# EAGLE board Backplane (EAGLE 6.6.0), part 2 of 2
## Tracks (layer width: path | path; a pad name or v marks a point on that pad's centre or on a via)
1AVAL
  Top 0.203: R42.1 68,72.38 C22.1 66.01,73.66 65.53,74.14 60.2,74.14 59.03,72.97 51.71,72.97 51.5,73.19 U1.42
2AVAL
  Top 0.203: R28.1 63.37,72.53 C24.1 51.25,72.53 50.7,73.08 U1.41
3AVAL  (via drill 0.6)
  Top 0.203: R7.1 73.15,72.25 C14.1 71.42,73.94 70.56,74.8 58.93,74.8 v58.17,74.04 | v49.89,72.26 49.89,74.12 U1.40
  Bottom 0.203: v58.17,74.04 57.4,73.18 56.49,72.26 v49.89,72.26
+5V  (via drill 0.5, 0.6)
  Top 0.203: v79.76,65.51 80.19,65.08 U13.16 81.61,65.08 81.58,65.05 81.69,65.05 81.79,65.15 81.48,65.15 | 81.79,50.72 81.69,50.82 U14.16 81.69,52.09 v81.58,52.2 | U15.16 81.69,37.76 v81.64,37.82 | U2.8 45.9,95.5 46.08,95.68 v46.08,96.19 | JP1.2 36.27,79.32 36.17,79.22
  Top 0.254: 24.38,154.43 R49.2 24.38,156.83 R11.2 | 99.09,31.7 U11.8 | 99.09,31.7 99.09,32.31 99.11,32.79 99.03,32.87 C5.1 | 99.09,31.7 99.11,31.62 v99.11,31.88 | U1.28 45.25,79.93 C10.1 45.72,82.17 v45.77,82.22 | U1.7 53,80.73 52.83,80.9 52.83,82.37 v52.48,82.73
  Top 0.305: R1.2 96.95,63.04 v97.41,63.5 | 24.38,154.43 23.24,154.43 v22.61,155.07 | 24.38,156.83 24.14,156.83 24,156.97 | R17.2 32.52,156.07 v32.39,156.21 | R4.2 R3.2 66.53,97.43 v66.5,97.46 | U3.8 107.57,71.83 v107.75,72.01
  Bottom 0.203: 79.76,65.41 v79.76,65.51 80.07,65.83 C15.1 | 81.53,52.15 v81.58,52.2 81.99,51.79 C16.1 | 81.53,37.82 v81.64,37.82 81.99,37.47 C21.1 | R2.2 33.51,78.7 34.09,79.27 36.32,79.27 JP1.2 | v45.77,82.22 45.77,80.45 C10.1 | v107.75,72.01 107.59,72.01 107.54,71.96
  Bottom 0.254: v99.11,31.88 99.11,31.93 | v52.48,82.73 52.48,81.06 C11.1
  Bottom 0.305: v97.41,63.5 97.41,63.63 | v22.61,155.07 22.61,155.32 | v32.39,156.21 32.39,156.34 | v66.5,97.46 66.5,97.51 | C20.1 108.2,71.55 v107.75,72.01
  other vias: 88.65,140.34 90.73,140.34 92.76,140.34 94.79,140.34 96.88,140.34 88.65,136.27
  pour Route15 (rank 4): 0.61,0.61 116.38,0.41 116.38,179.93 0.51,179.88
  pour Top: 97.99,140.44 97.99,136.73 97.79,136.53 91.64,136.53 90.98,135.86 90.98,135 90.63,134.65 88.34,134.65 87.78,135.2 87.78,140.59 88.39,141.2 97.18,141.2
+9V  (via drill 0.5)
  Top 0.254: R25.2 97,60.71 v97.38,61.09 | v113.89,100.86 113.59,100.56
  Top 0.305: v112.01,92.94 112.01,93.22 112.52,93.73 | U9.6 113.36,91.11 v113.03,91.19 | v12.83,158.24 12.83,158.75
  Bottom 0.254: v97.38,61.09 98.65,61.09 99.01,61.44 99.01,67.84 97.64,69.22 97.64,70.43 98.5,71.3 100.43,71.3 100.69,71.55 100.69,83.19 99.97,83.9 97.38,83.9 96.93,84.35 96.93,98.43 97.54,99.03 105.46,99.03 107.14,100.71 107.14,100.76 107.75,101.37 113.39,101.37 v113.89,100.86
  Bottom 0.305: R40.1 109.58,90.91 109.86,91.19 111.38,91.19 111.63,91.44 111.63,92.51 v112.01,92.94 | v113.03,91.19 113.03,92.46 114.81,94.23 114.81,163.96 112.78,165.99 106.81,165.99 102.87,169.93 14.99,169.93 13.21,168.15 13.21,158.62 v12.83,158.24
  other vias: 11.13,124.54 12.29,124.54 13.46,124.54 14.68,124.54 11.73,123.42 12.9,123.42 14.07,123.42
  pour Top: 14.99,157.48 14.99,123.7 14.1,122.81 11.05,122.81 10.54,123.32 10.54,156.72 11.43,157.61 14.86,157.61
  pour Top (rank 2): 111.51,85.09 115.57,85.09 116.46,85.98 116.46,165.35 114.43,167.39 108.84,167.39 104.27,171.96 13.46,171.96 11.3,169.8 11.3,157.61 12.19,156.72 14.99,156.72 15.37,157.1 15.37,166.62 17.53,168.78 101.22,168.91 106.05,163.45 111.63,163.45 113.41,161.54 113.41,96.39 111.38,94.36 111.38,85.22
  pour Bottom: 14.73,108.43 15.34,109.04 15.34,125.15 14.88,125.6 11.07,125.6 10.57,125.09 10.57,109.14 11.28,108.43
  pour Top (no thermals): 101.9,136.47 104.14,136.47 105.05,135.51 105.05,133.83 105.41,133.48 113.59,133.48 113.79,133.68 113.79,136.17 113.59,136.37 107.19,136.37 105.87,137.69 101.9,137.69
+24V  (via drill 0.5, 0.6)
  Top 0.254: R15.2 98.3,58.42 98.93,59.06 v98.93,69.85
  Top 0.305: R14.2 40.3,45.88 40.69,45.49 42.34,45.49 JP5.2
  Top 0.813: v30.78,64.74 30.78,51.77 v30.58,51.56 | C8.A 87.4,73.08 U12.2
  Top 1.016: v98.93,69.85 99.31,69.85 99.57,70.1 | K1.A1 34.73,42.1 32.72,44.12 32.72,49.43 v30.58,51.56
  Top 1.27: JP6.1 JP6.2
  Bottom 0.254: RPU13.2 104.95,32.89
  Bottom 0.406: U7.6 112.52,14.86 113.28,15.62 115.19,15.62 115.57,16 115.57,25.53 113.92,27.18 105.79,27.18 105.03,27.94 105.03,29.85 105.16,29.97 105.16,30.25 Q7.2
  Bottom 0.61: D8.C 28.46,64.55 28.65,64.74 v30.78,64.74
  Bottom 0.813: K7.A3 v30.58,51.56 28.58,51.56 | 28.58,51.56 28.58,53.48 D5.C | D7.C 28.46,51.45 28.58,51.56 | K8.A3 28.32,64.77 | 28.32,64.77 28.32,62.88 D8.C | 28.32,64.77 28.32,66.66 D6.C | Q7.3 Q7.2
  Bottom 1.016: v98.93,69.85 99.19,70.1 100.08,70.1 100.84,69.34 100.84,64.9 104.95,60.78 104.95,32.89 Q7.2 Q7.1 | D1.C 32.64,41.15 33.73,42.24 35.41,42.24 K1.A1 35.58,42.14 37.29,42.14 38.4,43.26 38.4,54.28 39.4,55.27 40.79,55.27 | JP4.1 JP3.1 40.79,55.27 | 40.79,55.27 40.49,55.58 40.49,59.56 43.08,62.15 43.08,65.1 45.11,67.13 49.43,67.13 50.6,68.3 57.96,68.3 60.15,70.49 60.15,82.73 62.64,85.22 72.9,85.22 74.22,83.9 74.22,77.9 75.64,76.48 80.67,76.48 81.89,75.26 v81.89,71.81
  other vias: 81.89,73.08
  pour Top (no thermals): 86.49,74.47 105.54,74.42 105.66,74.3 105.66,69.72 104.77,68.83 87.55,68.83 86.49,69.65
  pour Bottom: 34.85,43.26 37.34,43.26 38.4,44.32 38.4,45.59 39.01,46.2 43.54,46.2 43.89,45.85 43.89,41.63 43.54,41.28 35,41.28 34.7,41.58 34.7,43.1
  pour Top: 86.97,70.03 84.18,70.03 83.01,71.2 81.69,71.2 81.28,71.6 81.28,73.28 81.58,73.58 86.66,73.58 86.92,73.33 86.92,70.08
AIR-BOT+PRE
  Top 0.203: U6.16 26.36,18.97 R19.2
  pour Top (no thermals): 17.78,13.21 17.78,15.49 19.3,17.02 19.3,19.81 19.56,20.07 23.62,20.07 23.88,19.81 23.88,17.02 22.61,15.75 21.08,15.75 20.57,15.24 20.57,12.95 20.07,12.45 18.29,12.45
AIR-P
  Bottom 2.54: X2.1 40.83,24.32 39.5,22.99 39.5,13.8 J1.8
AIR-TOP
  Top 0.203: R18.2 14.56,19.02 U6.9
  pour Top (no thermals): 13.97,12.7 13.97,19.56 14.48,20.07 18.54,20.07 18.8,19.81 18.8,17.53 18.03,16.76 17.02,16.76 16.51,16.26 16.51,12.95 15.75,12.19 14.48,12.19
AMD-SEN  (via drill 0.5)
  Top 0.203: U$6.28 87.48,123.04 87.48,117.65 85.5,115.67 18.14,115.67 12.95,110.49 10.67,108.05 9.6,106.99 4.57,106.99 4.27,106.68 4.27,51.49 4.42,51.33 4.42,48.49 3.91,47.98 3.91,13.79 4.27,13.44 7.98,13.44 v8.18,13.64
  Bottom 0.203: v8.18,13.64 8.18,3.63 8.99,2.82 14.78,2.82 15.24,3.28 15.24,5.46 J1.17
B-LIGHT
  Bottom 0.305: Q7.8 102.29,25.22 101.73,25.78 101.73,26.9 RPU15.2
  Bottom 1.016: J2.23 105.94,9.55 107.19,10.8 107.19,24.77 | 107.19,24.77 106.73,25.22 Q7.6 Q7.7 Q7.8 | 107.19,24.77 107.19,24.92 Q7.5
B-LIGHT-C  (via drill 0.5)
  Top 0.305: U$1.24 77.47,99.44 78.49,98.43 100.46,98.43 v101.6,97.28
  Bottom 0.254: QE4.1 RPU14.2
  Bottom 0.305: v101.6,97.28 101.6,71.12 103.12,69.6 103.12,65.41 107.19,61.34 107.19,35.94 109.22,33.91 109.22,31.24 109.47,30.99 110.93,30.99 QE4.1
BMS-P
  Top 0.254: R46.2 55.65,48.36 56.32,47.69
  Top 1.422: J2.1 60.42,15.9 55.37,20.96 55.37,46.74 56.32,47.69 57.28,48.64 59.94,48.64 60.07,48.77
  pour Top (no thermals): 59.05,46.74 63.12,46.74 63.5,47.12 63.37,51.05 63.12,51.31 59.05,51.31
BOTS-SEN  (via drill 0.5)
  Top 0.203: U$6.29 90.07,123.09 90.07,117.65 87.48,115.06 18.44,115.06 13.56,110.19 11.28,107.75 9.91,106.38 5.33,106.38 4.88,105.92 4.88,51.54 5.03,51.38 5.03,48.34 4.52,47.83 4.52,14.55 4.88,14.2 6.45,14.2 v6.81,14.55 | v7.06,5.31 11.01,5.31 J1.16
  Bottom 0.203: v6.81,14.55 6.81,12.62 7.52,11.91 7.52,5.77 v7.06,5.31
BPD-R-SET  (via drill 0.6)
  Top 0.305: v80.52,113.28 80.26,113.54 19.05,113.54 10.92,105.41 10.92,95.5 9.4,93.98 6.86,93.98 6.35,93.47 6.35,52.25 7.67,50.93 22.3,50.93 23.52,49.71 25.2,49.71 25.96,50.47 25.96,61.54 25.35,62.15 25.35,65.3 25.04,65.61 20.07,65.61 v19.86,65.81
  Bottom 0.254: 81.28,124.46 81.28,114.05
  Bottom 0.305: U$6.57 81.28,124.46 | 81.28,114.05 v80.52,113.28 | R34.2 19.89,65.79 v19.86,65.81
BPD-SEN  (via drill 0.5)
  Top 0.203: U$6.23 74.93,119.74 73.91,118.72 14.02,118.72 10.67,115.37 1.96,115.37 v1.93,115.39 | K8.22 20.25,61.77 19,63.02 8.18,63.02 v8.03,63.12
  Bottom 0.203: v8.03,63.12 7.42,63.12 6.05,64.49 6.05,93.04 4.17,94.92 4.17,114.53 3.3,115.39 v1.93,115.39
CLEAR  (via drill 0.5)
  Top 0.203: U15.10 79.53,29.01 v79.5,28.98 | v79.25,43.21 81.67,43.21 U14.10 | v79.3,57.43 79.32,57.46 U13.10 81.67,57.43 82.25,57.43 82.7,57.89 82.7,66.01 80.11,68.61 80.11,76.23 78.03,78.31 59.94,78.31 56.72,81.53 U1.8
  Bottom 0.203: v79.5,28.98 79.25,29.03 v79.25,43.21 v79.3,57.43
CLK  (via drill 0.5)
  Top 0.203: U15.11 78.46,30.28 v78.38,30.35 | U14.11 81.67,44.53 v78.38,44.53 77.72,44.53 77.52,44.73 77.52,46.46 77.98,46.91 77.98,58.45 | U13.11 78.26,58.73 77.98,58.45 | 77.98,58.45 77.98,58.55 77.77,58.75 77.77,75.36 76.61,76.53 58.37,76.53 57.35,77.55 54.91,77.55 U1.3
  Bottom 0.203: v78.38,30.35 v78.38,44.53
CSENSE
  Top 0.203: 54.15,84.96 57.4,84.96 57.96,84.51 57.96,82.58 60.71,79.78 78.89,79.78 81.53,77.14 81.53,75.57 82.04,75.06 109.02,75.06 110.29,73.79 110.29,69.82 109.63,69.16 U3.7
  Top 0.254: U1.19 47.5,84.46 47.75,84.2 53.39,84.2 54.15,84.96
DATA-IN
  Top 0.203: U13.14 79.53,62.54 78.49,63.58 78.49,75.72 77.01,77.14 58.83,77.14 57.66,78.31 57.63,78.33 U1.4
DDS-P
  Top 0.305: R59.2 73.88,23.89 73.61,23.62
  Top 1.422: 62.61,27.86 62.61,25.53 64.52,23.62 73.61,23.62 83.31,23.62 84.33,22.61 84.33,13.65 J2.7
  pour Top (no thermals): 61.37,27.61 61.37,32.13 63.5,32.13 63.6,32.03 63.6,25.88 63.4,25.68 61.47,25.68 61.37,25.78
ECU-RELAY  (via drill 0.5, 0.6)
  Top 0.254: v8.48,38.43 19.3,38.43 v20.27,39.4
  Top 0.305: v40.89,95.63 29.51,95.63 v27.94,97.16
  Bottom 0.254: 8.13,50.77 8.13,38.79 v8.48,38.43 | v20.27,39.4 24.28,39.4 25.65,40.77 25.65,42.55 26.42,43.31 28.16,43.31 R33.2
  Bottom 0.305: U$1.25 80.01,101.09 79.12,100.2 42.44,100.25 42.27,100.25 41.86,99.85 41.86,96.6 v40.89,95.63 | v27.94,97.16 11.13,97.16 8.48,94.51 8.48,94.46 7.67,93.65 7.67,66.17 9.55,64.29 9.55,62.71 8.13,61.29 8.13,50.77
ECU-SEN
  Top 0.203: U$6.30 92.71,117.35 89.73,114.36 18.8,114.36 9.84,105.41 9.84,104.78 10.1,104.52 10.1,95.76 9.33,95 6.48,95 5.52,94.04 5.52,51.79 5.54,51.79 7.11,50.22 20.68,50.22 21.95,48.95 21.95,36.35 K1.22 20.19,34.6
FAN
  pour Bottom (rank 4): 42.93,25.27 42.93,13.08 40.89,11.05 36.32,11.05 35.81,10.54 35.81,8.38 36.32,7.87 41.91,7.87 49.53,15.49 49.53,24.89 48.64,25.78 43.43,25.78
FROM-TSMS  (via drill 0.5, 0.6)
  Top 0.203: 38.46,48.74 38.46,38.74 36.37,36.65 24.69,36.65 23.88,35.84 23.88,33.1 22.81,32.03 16.36,32.03 15.24,30.91 15.24,26.24 15.8,25.68
  Top 0.254: v43.74,110.72 43.74,110.31 43.23,109.8 20.73,109.8 14.78,103.86 14.78,74.96 15.95,73.79 35.81,73.79 38.46,71.15 38.46,48.74 | 15.8,25.68 15.8,24.08 v16,23.88 | v18.54,23.88 U6.EP
  Bottom 0.254: U$6.12 46.99,122.45 44.65,120.12 44.65,111.63 v43.74,110.72
  other vias: 17.27,23.88 19.81,23.88 21.08,23.88 22.35,23.88 22.35,22.61 21.08,22.61 19.81,22.61 18.54,22.61 17.27,22.61 16,22.61 16.76,21.59 18.03,21.59 19.3,21.59 20.57,21.59 21.84,21.59
  pour Bottom (no thermals): 21.59,12.95 21.59,16.26 21.08,16.76 17.27,16.76 15.24,18.8 15.24,23.88 15.75,24.38 24.64,24.38 25.15,23.88 25.15,15.75 24.64,15.24 24.64,12.95 24.13,12.45 22.1,12.45
GND  (via drill 0.5, 0.6)
  Top 0.203: U5.4 73.33,60.05 75.18,61.9 77.01,61.9 77.22,61.7 77.22,55.25 76.91,54.94 76.45,54.94 v76.35,54.84 76.04,55.15 U13.8 | v77.88,27.81 76.17,27.81 U15.8 76.07,27.71 75.18,27.71 74.37,26.9 70.97,26.9 70.66,27.2 70.66,31.47 70.94,31.75 U8.4 | U14.8 76.09,40.77 | 76.09,40.77 v76.45,40.41 | U10.4 71.04,45.72 70.82,45.49 70.82,41.12 71.07,40.87 76,40.87 76.09,40.77 | v81.53,40.61 81.53,40.67 | v76.4,66.57 76.15,66.32 71.93,66.32 71.57,66.68 R41.2 71.57,70.31 C14.2 71.26,70.28 70.41,70.28 69.29,71.4 66.65,71.4 66.6,71.45 65.99,71.45 | 66.01,68.28 C22.2 66.01,71.43 65.99,71.45 | R57.2 66.01,68.19 66.01,68.28 | R60.2 61.39,68.57 C24.2 62.11,71.45 65.99,71.45 | 66.01,68.28 66.19,68.45 66.09,68.45 65.99,68.55 65.99,70.69 | LED8.C 12.24,26.09 11.99,26.34 8.89,26.34 v8.43,26.8 | 23.17,92.25 LED3.C | LED9.C 26.31,22.57 v26.62,22.89 | 108.84,26.16 108.84,26.77 108.86,26.8 108.86,26.95 108.66,27.15 106.04,27.15 L1.OUT-
  Top 0.254: R51.1 26.42,155.58 v26.16,155.83 R16.1 | R48.1 36.32,155.45 36.58,155.19 38.1,155.19 v38.35,154.94 | VIN.C 9V.C 87.06,60.78 5V.C 87.16,56.94 v87.15,56.46 | v108.84,26.04 108.84,26.16 | LED4.C 58.74,50.59 58.88,50.72 58.88,54.18 58.67,54.38 56.18,54.38 v55.88,54.69 | LED12.C 50.88,43.99 v50.95,43.92 | LED11.C 100.42,35.29 v99.47,36.25 99.09,35.87 99.09,35.06 C5.2 | C13.2 99.17,26.84 U11.5 99.09,25.3 99.26,25.12 100.23,25.12 v100.63,24.71 | v26.01,48.84 25.96,48.79 | v22.86,71.35 22.86,71.3 | LED10.C 53.43,58.54 v53.9,59 | LED5.C 70.76,39.4 71.63,40.26 76.3,40.26 v76.45,40.41 | U2.5 40.56,99.31 v40.18,99.7 | U1.29 45.29,79.13 C10.2 45.72,76.84 v45.67,76.78 | U1.6 53.05,79.93 C11.2 52.32,77.39 v52.07,77.14 | R13.1 44.78,52.21 C27.2 43.75,52.13 43.64,52.25 43.64,53.21 v43.79,53.37 | U6.4 19.69,30.79 20.22,31.37 23.32,31.37 25.55,33.6 v25.55,34.82
  Top 0.305: LED3.C 23.23,89.65 LED6.C 23.22,92.63 22.76,93.09 21.03,93.09 20.22,93.9 v20.22,94.77 | U3.5 109.63,66.62 v109.88,66.37 110.05,66.54 C28.2 | LED14.C 78.78,16.73 v78.54,16.48 | LED17.C 80.43,26.38 80.06,26.75 78.08,26.75 77.77,27.05 77.77,27.71 v77.88,27.81 | R8.1 42.42,39.58 C26.2 44.84,39.58 45.26,40.01 45.26,43.1 46.13,43.97 50.9,43.97 v50.95,43.92 | C25.2 30.19,28.32 R21.2 30.02,28.32 30.33,28.02 30.33,29.29 v30.38,29.34
  Top 0.406: U12.3 96.6,78 v96.77,78.05 96.88,78.16 100.03,78.16 100.33,77.85 C1.C | C8.C 87.22,76.38 v87.93,77.09
  Top 0.61: C4.C 78.16,174.19 v77.85,174.5 | v22.45,57.79 22.5,57.79 | v26.31,62.81 26.37,62.76
  Top 0.813: v30.28,41.83 30.28,41.88 30.33,41.94 | C7.C 90.78,94.51 v90.22,95.07 | R52.1 41.57,64.24 Q1.2 41.57,65.95 v41,66.52 | Q2.2 R54.1 47.51,62.68 47.35,62.51 45.82,62.51 v45.67,62.66 | v114.15,28.42 111.05,28.42 110.85,28.22
  Top 1.016: U9.3 111.46,78.16 v111.13,78.49
  Bottom 0.203: C21.2 81.99,28.68 81.03,27.71 77.98,27.71 v77.88,27.81 | v76.45,40.41 76.5,40.41 | v76.35,54.84 76.4,54.79 | C16.2 81.99,41.07 v81.53,40.61 | C15.2 82.25,69.06 v82.6,69.47 | v76.4,66.57 76.4,66.52 | v8.43,26.8 8.53,26.8 | R24.2 96.49,76.29 96.77,76.58 v96.77,78.05 | v45.67,76.78 45.67,78.65 C10.2 | v26.62,22.89 26.57,22.94 | SJ1.3 25.76,37.41 26.11,37.06 29.62,37.06 29.77,37.21 29.77,37.82 Q10.2
  Bottom 0.254: v26.16,155.83 26.16,155.96 | v38.35,154.94 38.48,154.81 | v87.15,56.46 87.2,56.49 | U7.3 112.52,19.69 113.03,20.19 114.43,20.19 114.81,20.57 114.81,24.89 113.67,26.04 v108.84,26.04 | v55.88,54.69 55.93,54.69 55.98,54.74 | v50.95,43.92 50.95,44.02 51.05,44.12 | v99.47,36.25 99.52,36.25 99.57,36.3 | v100.63,24.71 100.58,24.71 | R36.1 25.75,61.1 Q13.2 | 25.75,70.5 Q12.2 | v53.9,59 53.85,59 | v40.18,99.7 40.08,99.8 | v52.07,77.14 52.07,78.96 C11.2 | v43.79,53.37 43.74,53.42 | v25.55,34.82 25.5,34.82 25.45,34.87
  Bottom 0.305: R39.2 109.6,78.74 109.86,78.49 v111.13,78.49 | Q10.2 29.98,38.13 R30.1 29.98,38.19 29.97,38.18 | 109.98,66.37 v109.88,66.37 109.63,66.62 108.56,66.62 108.2,66.98 C20.2 | v20.22,94.77 20.17,94.77 20.12,94.72 | v78.54,16.48 78.59,16.43 | v30.38,29.34 30.43,29.39
  Bottom 0.406: R35.1 25.75,47.13 Q6.2 | v87.93,77.09 87.99,77.09
  Bottom 0.61: v77.85,174.5 77.85,174.75 | 25.75,70.5 R29.1 23.71,70.5 v22.86,71.35 | 25.75,47.13 25.75,48.58 v26.01,48.84 | R31.1 24.31,57.34 Q4.2 22.9,57.34 v22.45,57.79 | 25.75,61.1 25.75,62.25 v26.31,62.81
  Bottom 0.813: 29.97,38.18 29.97,41.53 v30.28,41.83 | v41,66.52 40.94,66.52 | v45.67,62.66 45.62,62.71 | QE4.2 113.06,28.74 RPU14.1 113.73,28.84 v114.15,28.42
  Bottom 1.016: v111.13,78.49 111.13,78.36
  other vias: 103.86,173.18 113.03,41.78 111.76,41.78 112.27,40.51 113.54,40.51 113.54,39.24 112.27,39.24 113.54,37.97 113.54,36.7 113.54,35.43 113.54,34.16 114.33,53.49 114.33,55.93 114.43,62.84 114.35,46.99 92.79,67.23 88.82,95.07 87.43,95.07 106.32,94.74 105.59,93.73 104.83,94.74 100.38,136.32 99.42,135.2 100.63,134.39 99.36,133.48 100.48,132.51 99.31,131.55 92.79,65.81 86.31,162.23 88.8,162.28 91.39,162.13 83.87,151.56 95.55,151.41 95.5,161.72 82.85,161.93
  pour Route2: 0.66,0.66 116.33,0.46 116.33,179.88 0.56,179.83
  pour Top (no thermals): 109.73,30.35 109.73,38.99 109.22,39.5 109.22,41.78 109.73,42.29 113.54,42.29 114.05,41.78 114.05,30.35
  pour Top: 108.46,46.23 108.46,63.25 108.84,63.63 114.68,63.63 115.19,63.12 115.19,46.56 114.4,45.72 108.97,45.72
  pour Top (no thermals): 105.41,26.54 105.41,28.07 106.43,29.08 109.22,29.08 109.6,29.46 109.6,30.23 112.01,30.23 112.01,27.43 111.12,26.54
  pour Top: 92.3,67.49 92.56,67.74 98.25,67.74 98.37,67.61 98.37,65.2 98.25,65.07 92.68,65.07 92.3,65.46
  pour Top (rank 4): 106.3,94.11 106.3,88.77 105.66,88.14 103.89,88.14 103.38,88.65 103.38,93.98 103.86,94.36 106.15,94.36
  pour Top (rank 4): 106.3,95.25 106.3,89.92 105.66,89.28 103.89,89.28 103.38,89.79 103.38,95.12 103.76,95.5 106.05,95.5
  pour Top (rank 4): 106.55,95.25 106.55,89.92 105.92,89.28 104.14,89.28 103.63,89.79 103.63,95.12 104.01,95.5 106.3,95.5
  pour Top (rank 4): 106.3,95.25 106.3,89.92 105.66,89.28 103.89,89.28 103.38,89.79 103.38,95.12 103.76,95.5 106.05,95.5
  pour Top (rank 4): 106.93,95.25 106.93,89.92 106.3,89.28 104.52,89.28 104.01,89.79 103.89,95 104.39,95.5 106.68,95.5
  pour Top: 86,95.63 90.78,95.63 91.14,95.28 91.14,89.94 90.58,89.38 86.06,89.38 85.75,89.69 85.75,95.38
  pour Top (no thermals): 91.9,134.24 95.55,134.24 96.01,133.78 98.5,133.78 98.5,130.73 101.35,130.73 101.35,133.78 103.78,133.78 103.78,135.81 101.14,135.81 101.14,139.17 98.55,139.17 98.55,135.97 98.45,135.86 92.35,135.86 91.9,135.41
  pour Top (no thermals): 91.9,134.24 95.55,134.24 96.01,133.78 98.5,133.78 98.5,130.73 101.35,130.73 101.35,133.83 103.78,133.78 103.78,135.81 101.19,135.81 101.19,139.17 98.55,139.17 98.55,135.97 98.45,135.86 92.35,135.86 91.9,135.41
  pour Top: 82.35,164.92 96.27,164.92 96.27,150.5 82.35,150.5
H-EN  (via drill 0.5, 0.6)
  Top 0.305: U$1.23 74.93,100.2 77.85,97.28 99.95,97.28 101.47,95.76 102.49,95.76 v102.87,96.14
  Top 0.406: v110.08,15.93 113.59,15.93 115.37,17.55 v115.37,30.86
  Bottom 0.203: U7.1 109.98,16.03 v110.08,15.93
  Bottom 0.254: U7.8 U7.1
  Bottom 0.305: v102.87,96.14 102.87,71.37 104.27,69.98 104.27,65.66 107.95,61.98 107.95,36.83 110.62,34.16 110.62,32.39 111.13,31.88 114.81,31.88 115.09,31.6 115.32,31.37
  Bottom 0.406: v115.37,30.86 115.37,31.32 115.09,31.6
H-SIG  (via drill 0.5, 0.6)
  Top 0.254: v115.32,33.05 115.98,33.05 116.28,32.74 116.28,16.84 114.3,14.86 109.37,14.86 109.02,15.21 v109.02,20.75
  Top 0.305: U$1.22 72.39,100.58 76.58,96.39 99.44,96.39 100.84,95 103.51,95 104.52,96.01 v104.52,96.65
  Bottom 0.254: U7.4 113.79,17.02 113.54,16.76 111.63,16.76 111.25,17.15 U7.2 111.15,18.72 111.15,19.18 111.2,19.23 111.2,19.99 110.44,20.75 v109.02,20.75 | 114.94,33.02 115.29,33.02 v115.32,33.05
  Bottom 0.305: v104.52,96.65 104.52,96.01 103.76,95.25 103.76,71.88 105.28,70.36 105.28,65.79 108.84,62.23 108.84,37.34 111.63,34.54 111.63,33.4 112.01,33.02 114.94,33.02
HCMESURE  (via drill 0.6)
  Top 0.203: U1.31 42.3,77.53 42.16,77.39 42.16,74.45 42.42,74.19 v43.18,74.19 | U11.7 97.92,29.46 97.54,29.85 97.54,33.3 97.79,33.55 97.79,36.5 98.81,37.52 98.81,54.03 96.11,56.72 88.95,56.72 88.14,57.53 88.14,64.34 v87.43,65.05 | v87.48,78.87 81.08,78.87 79.35,80.59 61.37,80.59 58.93,82.98 v58.93,86.18
  Bottom 0.203: v43.18,74.19 47.29,74.19 48.11,73.38 56.03,73.38 58.93,76.28 v58.93,86.18 | v87.43,65.05 87.43,76.12 87.02,76.53 87.02,78.41 v87.48,78.87
HORN+
  Bottom 0.813: R44.2 105.2,4.78 J2.35
HORN-
  Bottom 0.813: R45.2 101.75,2.77 100.46,4.06 100.46,5.52 J2.34
IMD-INPUT  (via drill 0.6)
  Top 0.203: v49.33,108.69 49.17,108.69 48.82,108.33 26.62,108.33 25.4,107.16 v25.4,100.3 | v21.13,3.02 28.7,3.02 29.21,3.53 29.21,9.49 J1.13
  Bottom 0.203: U$6.14 52.07,121.13 50.55,119.61 50.55,109.91 v49.33,108.69 | v25.4,100.3 13.51,100.3 6.91,93.7 6.91,64.95 7.42,64.44 8.28,64.44 8.94,63.78 8.94,62.87 7.47,61.39 7.47,25.27 7.16,24.97 4.01,24.97 3.35,24.31 3.35,13.69 1.83,12.17 1.83,3.07 2.54,2.36 20.47,2.36 v21.13,3.02
IMD-R-SET  (via drill 0.6)
  Top 0.254: v20.57,51.99 7.77,51.99 7.11,52.65
  Top 0.305: v82.8,113.03 81.79,112.01 79.5,112.01 78.99,112.52 19.56,112.52 11.94,104.9 11.94,95.25 9.91,93.22 7.37,93.22 7.11,92.96 7.11,52.65
  Bottom 0.254: 83.82,124.46 83.82,114.05 | R32.2 20.64,51.93 v20.57,51.99
  Bottom 0.305: U$6.58 83.82,124.46 | 83.82,114.05 v82.8,113.03
IMD-SEN  (via drill 0.5, 0.6)
  Top 0.203: U$6.24 77.42,123.14 77.42,119.33 76.2,118.11 14.33,118.11 10.97,114.76 2.54,114.76 1.83,114.05 1.83,50.17 v2.03,49.96
  Top 0.254: v6.25,49.45 18.25,49.45 K7.22
  Bottom 0.203: v2.03,49.96 5.28,49.96
  Bottom 0.254: 5.28,49.96 5.69,49.96 v6.25,49.45
IS-SEN
  Top 0.203: U$6.22 72.39,120.09 71.63,119.33 13.56,119.33 10.21,115.98 3.05,115.98 2.62,116.41 0.91,116.41 0.61,116.1 0.61,2.31 1.52,1.4 18.29,1.4 19.3,2.41 19.3,5.39 J1.18
LAT  (via drill 0.5)
  Top 0.203: U13.12 79.27,60 v79.2,60.02 | v78.38,45.85 78.38,45.8 81.67,45.8 U14.12 | U15.12 78.71,31.55 78.54,31.72 78.54,34.47 78.28,34.72 v77.52,34.72 | v79.35,67.28 79.35,76.02 77.72,77.65 59.49,77.65 58.01,79.12 54.91,79.12 U1.5
  Bottom 0.203: v79.2,60.02 78.33,60.02 | 78.33,60.02 v78.38,45.85 77.52,45.85 v77.52,34.72 | 78.33,60.02 78.33,66.27 v79.35,67.28
LED1  (via drill 0.6)
  Top 0.203: U1.22
  Top 0.254: v45.67,83.95 45.06,84.56 45.06,85.7 U1.22 45.11,85.75 45.11,86.23 44.86,86.49 41.96,86.49 41,85.52 41,73.03 42.27,71.76 42.98,71.76 43.54,71.2 R53.2
  Top 0.305: R20.2 42.99,91.63 v43.08,91.72
  Bottom 0.254: v43.08,91.72 43.59,91.72 45.11,90.2 45.11,84.51 v45.67,83.95
LED2  (via drill 0.6)
  Top 0.203: 43.28,83.95 U1.23
  Top 0.254: v43.18,85.17 43.18,84.05 U1.23 41.95,83.93 41.66,83.64 41.66,73.18 42.47,72.36 46.74,72.36 47.55,71.55 47.55,70.16 R55.2
  Top 0.305: R10.2 41.52,89.55 v42.16,90.2
  Bottom 0.254: v42.16,90.2 42.16,86.18 v43.18,85.17
LOOP-IN
  Bottom 1.676: K1.11 14.8,42.1 12.83,40.13 12.76,40.13 12.51,39.88 12.51,32.47 15.19,29.79 27.43,29.79 31.19,26.04 J1.6 31.31,13.61
MAIN  (via drill 0.6)
  Top 0.203: 37.49,48.18 37.49,39.09 35.71,37.31 24.23,37.31 23.11,36.2 23.11,33.5 22.35,32.74 15.6,32.74 14.53,31.78 14.53,28.85 U6.8
  Top 0.254: v41.35,110.82 20.73,110.82 14.17,104.27 14.17,74.35 15.65,72.87 35.66,72.87 37.49,71.04 37.49,48.18
  Bottom 0.254: U$6.10 41.91,111.38 v41.35,110.82
MCS-P
  Top 0.254: R47.2 57.66,39.4 57.4,39.65
  Top 1.27: 57.4,43.18 58.67,44.32 59.69,44.32 59.82,44.2 60.58,44.2 60.83,44.45 61.65,44.45
  Top 1.422: J2.3 68.42,17.68 67.31,18.8 60.96,18.8 57.4,22.35 57.4,39.65 57.4,43.18
  pour Top (no thermals): 59.05,46.1 63.37,46.1 63.37,41.78 62.99,41.4 59.05,41.4
N$1
  pour Top: 114.43,91.95 114.43,89.03 112.27,89.03 112.27,91.95
N$2
  Top 0.203: R18.1 LED8.A
N$3
  Top 0.406: U$2.4 94.89,132.89 R6.2 92.68,133.04 C2.1 90.45,133.09 R5.1
N$4
  Top 0.203: U10.8 76.04,50.8 U14.1
N$5
  Top 1.93: U$5.33 U$5.1 U$5.2 U$5.34
  pour Top (no thermals): 16.89,157.1 22.1,157.1 22.61,157.61 22.61,166.88 22.22,167.26 18.16,167.26 17.78,166.88 17.78,161.16 16.89,160.27
N$6
  Bottom 0.254: R32.1 22.73,55.37 22.81,55.45 24.22,55.45 R31.2 25.75,55.49 Q4.1
N$7
  Bottom 1.676: K7.11 14.29,55.31 12.83,53.85 12.83,44.78 K1.14
N$8
  Top 0.254: 9V.A R25.1
N$9
  Top 0.406: F2.1 20.07,132.64 20.07,130.3 20.19,130.3
  Top 1.93: U$6.33 U$6.1
  pour Top (no thermals): 18.41,121.92 21.84,121.92 22.35,122.43 22.35,133.35 21.34,134.37 17.14,134.37 16.89,134.11 16.89,131.57 17.27,131.19 18.16,131.19 18.41,130.94
N$10
  Top 0.203: R19.1 28.46,21.21 LED9.A
N$11
  Top 0.305: U6.7 15.88,27.64 16.36,27.15 24.74,27.15 25.6,26.29 26.38,26.29 R43.2 26.46,26.21 R21.1
N$12
  Top 1.93: U$1.2 U$1.1 U$1.33 U$1.34
  pour Bottom: 16.15,111.07 16.15,102.84 17.32,101.68 21.89,101.68 22.2,101.98 22.2,110.72 21.49,111.43 16.51,111.43
N$13
  Top 1.93: U$4.34 U$4.2 U$4.1 U$4.33
  pour Top (no thermals): 18.41,143.76 18.41,147.96 16.89,149.48 16.89,153.16 17.14,153.42 22.1,153.42 22.35,153.16 22.35,144.27 21.84,143.76
N$14  (via drill 0.6)
  Top 0.203: U6.2 22.23,30.18 22.86,30.81 23.77,30.81 26.42,33.45 27.08,33.45 27.69,34.06 v27.69,34.32
  Bottom 0.203: v27.69,34.32 27.69,34.82 26.62,35.89 24.33,35.89 24.13,36.09 24.13,37.36 SJ1.2
N$15
  Bottom 1.676: K8.11 13.28,68.52 12.57,67.82 12.57,57.74 K7.14
N$16
  Top 0.305: LED3.A 27.46,91.66 R20.1
N$17
  Top 0.254: R22.2 54.58,65.44 55.07,64.95 55.07,62.94 JP2.1
  Top 1.676: JP2.1 JP2.2 60.35,62.92 60.4,62.87
  pour Top (no thermals): 63.4,65.66 63.45,65.66 63.7,65.41 63.7,61.34 63.3,61.04 59.59,61.04 59.59,65.71 63.35,65.71
N$18
  Top 0.305: U3.6 109.78,67.89 110.13,68.25 111.77,68.25 C28.1
N$19
  Top 0.254: 5V.A R1.1
N$20
  Top 0.406: U$5.30 92.66,163.83 JP7.1
N$21
  Top 0.813: Q1.3 42.52,58.12 JP3.2
N$22
  Top 0.813: Q2.3 JP4.2
N$23
  Bottom 0.254: R38.2 22.73,45.47 22.96,45.24 24.17,45.24 R35.2 25.75,45.33 Q6.1
N$24
  Top 0.305: LED1.A 64.41,95.71 R3.1
N$25
  Top 0.305: LED2.A R4.1
N$26
  Top 0.305: Q1.1 R52.2 43.47,68 R53.1
N$27
  Top 0.305: Q2.1 49.41,64.24 R54.2 49.51,65.68 49.07,66.12 47.85,66.12 47.4,66.57 47.4,68.01 R55.1
N$28
  Top 0.254: LED10.A 52.3,63.41 R22.1
N$29
  Top 0.254: R27.1 LED12.A
N$30
  pour Top (no thermals): 99.57,68.2 104.65,68.2 104.65,61.85 105.99,60.5 105.99,44.15 108.15,41.99 108.03,31.06 108,30.33 103.53,30.33 103.53,37.62 99.59,41.55 99.59,52.32 99.54,55.17 99.54,57.71
  pour Top (no thermals): 104.77,26.42 104.77,28.07 106.43,29.84 106.43,30.73 105.03,30.48 103.5,30.48 103.38,30.35 103.38,26.54 103.5,26.42
N$31
  Top 0.203: U5.7 74.14,63.86 74.68,64.44 77.11,64.44 77.37,64.64 77.37,67.49 76.71,68.15 R41.1 73.57,70.24 R7.2
N$32
  Bottom 0.254: RPU13.1 107.44,32.89 107.57,32.77 107.57,30.53 Q7.4 108.42,30.45 QE4.3
N$33
  Top 0.203: U10.6 72.24,48.23 73.71,48.23 75.01,49.53 76.04,49.53 U14.2
N$34  (via drill 0.5)
  Top 0.254: v101.73,31.62 101.73,33.16 LED11.A
  Bottom 0.254: RPU15.1 101.65,31.55 v101.73,31.62
N$35
  Bottom 0.203: R26.2 C3.1
N$36
  Top 0.203: U10.5 72.24,47.02 73.91,47.02 75.16,48.26 76.04,48.26 U14.3
N$37  (via drill 0.5)
  Top 0.203: v91.03,80.09 93.01,80.09 93.47,80.54 93.47,81.76 93.83,82.12 96.44,82.12 U12.4
  Bottom 0.203: R24.1 93.22,79.97 C3.2 91.1,80.02 v91.03,80.09
N$38
  Top 0.406: U$5.29 90.12,163.83 JP7.2
N$39
  Top 0.203: U10.3 72.24,44.42 73.76,44.42 74.17,44.83 74.17,46.15 75.01,46.99 76.04,46.99 U14.4
N$40
  Top 0.203: JP1.4 38.3,84.4 38.66,84.76 38.66,87.96 39.07,88.37 48.31,88.37 49.12,87.55 49.12,85.76 U1.17
N$41
  Bottom 0.254: U$1.38 31.75,120.9 33.02,122.17 33.02,144.78 U$4.38
N$42
  Top 0.254: VIN.A R15.1
N$43
  Top 0.203: JP1.5 36.12,88.42 36.58,88.87 48.97,88.87 49.94,87.91 49.94,85.77 U1.16
N$44
  Top 0.203: U10.2 72.24,43.21 74.17,43.21 74.68,43.71 74.68,45.39 75.01,45.72 76.04,45.72 U14.5
N$45
  Bottom 1.016: K1.A2 35.53,34.62 33.22,34.62 32.64,35.2 D1.A 29.11,35.95 Q10.3
N$46
  Top 0.203: U1.18 48.3,87.52 48.06,87.76 39.57,87.76 39.27,87.45 39.27,84.35 38.61,83.69 38.61,77.19 38.1,76.68 36.22,76.68 JP1.1
  Bottom 0.203: R2.1 36,76.9 JP1.1
N$47
  Bottom 0.61: Q4.3 32.69,56.39 33.27,55.8 33.27,55.65 33.73,55.19
  Bottom 0.813: K7.A1 33.85,55.31 33.73,55.19 33.4,54.86 33.4,53.73 D5.A
N$48
  Bottom 0.305: R33.1 28.18,41.5 R30.2 28.18,38.13 Q10.1
N$49
  Bottom 0.61: Q6.3 32.54,46.23 33.32,47.02 33.32,47.29 33.85,47.81
  Bottom 0.813: K7.A2 33.85,47.81 33.4,48.26 33.4,49.39 D7.A
N$50
  Bottom 0.61: Q12.3 32.27,69.6 33.34,68.52
  Bottom 0.813: K8.A1 33.34,68.52 33.15,68.33 33.15,66.92 D6.A
N$51
  Bottom 0.61: Q13.3 33.03,60.2 33.85,61.02
  Bottom 0.813: K8.A2 33.85,61.02 33.4,61.47 33.4,62.6 D8.A
N$52
  Bottom 0.406: R44.1 113.23,4.78 114.17,5.72 114.17,10.54 113.16,11.56 111.76,11.56 111.25,12.07 U7.7
N$53
  Bottom 0.406: U7.5 113.79,12.07 114.94,10.92 114.94,3.81 113.79,2.67 111.67,2.67 R45.1
N$54
  Top 0.305: LED6.A 27.47,89.65 R10.1
N$55
  Bottom 0.254: R37.2 24.4,62.62 24.18,62.41 23.22,62.41 22.86,62.05 22.86,59.66 23.16,59.36 24.2,59.36 R36.2 25.75,59.3 Q13.1
N$56
  Top 0.406: U$5.28 87.58,163.83 JP7.3
N$57
  Bottom 0.254: U$1.37 29.21,120.9 30.48,122.17 30.48,144.78 U$4.37
N$58
  Bottom 0.254: Q12.1 25.75,68.7 R29.2 24.26,68.63 24.43,68.45 24.43,65.83 R34.1
N$59
  Bottom 0.305: C9.1 R40.2
N$60  (via drill 0.5)
  Top 0.305: U9.4 111.51,82.17 v111.38,82.3
  Bottom 0.305: v111.38,82.3 109.87,82.3 R39.1 109.6,83.78 C9.2
N$61
  pour Top (rank 4, no thermals): 97.16,46.23 97.16,34.42 95.63,32.89 95.63,29.59 95.25,29.21 89.28,29.21 88.01,30.48 88.01,46.1 88.77,46.86 96.52,46.86
N$62
  Top 0.203: U10.1 72.24,41.94 74.12,41.94 75.13,43 75.13,44.27 75.31,44.45 76.04,44.45 U14.6
N$63
  Top 0.254: C13.1 97.37,27.95 97.54,28.12 99.01,28.12 U11.6
N$64
  Top 0.203: U8.8 75.89,36.83
  Top 0.254: 75.89,36.83 U15.1
N$65
  Top 0.203: U8.6 72.14,34.32 73.81,34.32 74.85,35.36 U15.2
N$66
  Top 0.203: U8.5 72.19,33.1 73.66,33.1 74.65,34.09 U15.3
N$67
  Top 0.254: R46.1 LED4.A
N$68
  Top 0.254: R47.1 LED5.A
N$69  (via drill 0.5)
  Top 0.203: U10.7 74.04,49.53 74.73,50.22 77.11,50.22 77.27,50.37 77.27,52.65 76.96,52.96 75.29,52.96 v74.93,53.31 | 68.07,68.13 R57.1 68.06,70.36 R42.2
  Top 0.254: 68.07,68.13 69.46,68.13 69.95,67.64 69.95,66.78 v70.41,66.32
  Bottom 0.203: v74.93,53.31 74.93,65.96 74.22,66.68 70.76,66.68 v70.41,66.32
N$70
  Top 0.203: U15.4 74.75,32.82 73.91,31.98 73.91,30.81 73.61,30.51 72.14,30.51 U8.3
N$71
  Top 0.203: U15.5 74.75,31.55 74.37,31.17 74.37,29.74 73.81,29.18 72.14,29.18 U8.2
N$72
  Top 0.203: U15.6 75.16,30.28 74.88,30 74.88,28.83 74.07,28.02 72.75,28.02 72.69,27.97 72.14,27.97 U8.1
N$73
  Top 0.203: U13.1 72.31,65.08 U5.8
N$74
  Top 0.203: U13.2 74.85,63.81 73.61,62.56 72.29,62.56 U5.6
N$75
  Top 0.203: U13.3 74.85,62.54 73.66,61.34 72.29,61.34 U5.5
N$76
  Top 0.203: U13.4 75.21,61.27 74.22,60.27 74.22,59.16 73.86,58.8 72.29,58.8 U5.3
N$77
  Top 0.203: U13.5 75.06,60 74.68,59.61 74.68,58.24 73.91,57.48 72.29,57.48 U5.2
N$78
  Top 0.203: U13.6 75.36,58.73 75.08,58.45 75.08,56.87 74.42,56.21 72.29,56.21 U5.1
N$79
  Top 0.203: U15.14 80.8,34.09 80.42,34.47 80.42,39.4 80.57,39.55 82.14,39.55 82.65,40.01 82.65,47.42 82.45,47.68 80.87,47.68 80.06,48.44 80.06,55.7 80.54,56.19 U13.9
N$80
  Top 0.203: U15.9 82.88,27.74 83.06,27.91 83.06,48.03 82.75,48.34 81.72,48.34 U14.14
N$81
  Top 0.406: U$5.27 85.04,163.83 JP7.4
N$83
  Top 0.305: R58.1 LED14.A
N$84
  Top 0.305: R59.1 LED17.A
N$85  (via drill 0.5)
  Top 0.203: U8.7 74.09,35.56 74.52,35.99 77.01,35.99 77.22,36.2 77.22,37.67 76.35,38.53 75.23,38.53 v75.03,38.74 | 63.8,68.09 R60.1 63.75,68.21 63.75,69.52 63.45,69.82 R28.2
  Top 0.254: v68.48,66.22 64.72,66.22 63.91,67.03 63.91,68.06 R60.1
  Bottom 0.203: v75.03,38.74 75.03,51.03 73.66,52.4 73.66,64.8 73,65.46 69.24,65.46 v68.48,66.22
OUTEN  (via drill 0.5)
  Top 0.203: U13.13 80.24,61.27 v80.16,61.24 | v80.06,32.84 81.67,32.84 U15.13 | U14.13 80.14,47.04 v80.11,47.07 | U1.9 56.88,82.33 60.2,79.02 78.33,79.02 80.82,76.53 80.82,69.16 83.26,66.73 83.26,57.23 82.7,56.67 82.7,54.74 82.3,54.33 v81.43,54.33
  Bottom 0.203: v80.16,61.24 80.14,54.38 | 80.14,54.38 80.11,47.93 | 80.11,47.93 v80.11,47.07 | v80.11,47.07 v80.06,32.84 | v80.11,47.07 80.11,47.93 | v81.43,54.33 80.19,54.33 80.14,54.38
P+F
  pour Top (rank 4, no thermals): 39.12,30.48 43.56,30.48 44.58,29.46 44.58,21.59 44.07,21.08 44.07,11.43 43.05,10.41 43.05,3.81 42.04,2.79 39.24,2.79 37.72,4.32 37.72,6.73 38.48,7.49 39.75,7.49 40.26,8 40.26,11.3 41.4,12.45 41.4,15.11 40.39,16.13 38.23,16.13 37.97,16.38 37.97,29.34
PRE+  (via drill 0.6)
  Top 0.203: 22.86,108.64 22.86,100.61 | 39.01,49.5 39.01,46.1 38.99,45.92 38.96,45.85 38.96,32.13 37.24,30.35 23.98,30.35 23.5,29.82 U6.1
  Top 0.254: v47.96,110.62 47.96,110.26 46.84,109.14 23.32,109.14 22.86,108.64 | 22.86,100.61 21.39,99.19 17.07,99.19 15.75,97.87 15.75,75.46 16.56,74.65 35.97,74.65 39.01,71.6 39.01,49.5
  Bottom 0.254: U$6.13 49.53,121.34 48.36,120.17 48.36,111.02 v47.96,110.62
RAVAL
  Top 0.305: R43.1 30.44,26.19 C25.1
RELAY-SET  (via drill 0.6)
  Top 0.254: v85.6,113.03 83.82,111.25 78.99,111.25 78.49,111.76 20.32,111.76 12.95,104.39 12.95,94.74 10.67,92.46 8.13,92.46 7.87,92.2 7.86,65.05 | 7.86,65.05 8.57,64.39 | 7.86,65.05 9.03,63.93 v20.68,63.93 20.73,63.98 24.13,63.98 24.79,63.32 v24.79,50.98
  Bottom 0.254: U$6.59 86.36,124.46 86.36,113.79 v85.6,113.03 | R37.1 20.75,64.01 v20.68,63.93 | R38.1 24.5,50.68 v24.79,50.98
RS1-A  (via drill 0.6)
  Top 0.203: J2.6 84.38,10.95 J2.8
  Top 0.254: U$1.3 24.13,97.54 28.19,93.47 77.47,93.47 v78.23,92.71 | R11.1 24.26,160.11 R12.2 24.32,163.64 U$5.3
  Bottom 0.203: 80.26,13.71 J2.6 80.62,13.75 80.62,15.67 84.58,19.63 84.58,81.97 83.57,82.98 80.21,82.98 78.23,84.96 v78.23,92.71 | JP8.1 24.16,151.99 24.13,152.02
  Bottom 0.254: U$1.3 22.86,104.14 22.86,121.16 24.13,122.43 U$6.3 22.86,124.46 22.86,127.51 24.13,128.78 U$4.3 22.86,144.78 22.86,147.07 24.13,148.46 24.13,152.02 U$5.3
RS1-B  (via drill 0.6)
  Top 0.203: JP8.2 33.07,154.61 32.66,155.02 28.04,155.02 27.94,154.91 | J2.17 82.4,6.93 J2.19
  Top 0.254: v81.18,92.71 79.5,94.49 28.96,94.49 26.67,96.77 U$1.4 | U$6.4 26.92,123.19 27.94,124.21 27.94,143.51 | 27.94,143.51 U$4.4 | 27.94,143.51 27.94,154.91 27.94,162.56 U$5.4 26.12,163.28 R12.1 26.16,160.13 R16.2
  Bottom 0.203: J2.19 86.41,15.52 85.09,16.84 85.09,82.27 82.35,85.01 82.35,91.87 81.51,92.71 v81.18,92.71
  Bottom 0.254: U$6.4 26.67,122.43 25.4,121.16 25.4,104.14 U$1.4
RS2-A  (via drill 0.6)
  Top 0.203: v70.46,19.13 71.42,19.13 71.98,18.57 71.98,13.99 J2.4
  Top 0.254: U2.6 35.89,98.04 34.29,99.7 U$1.7 | R17.1 34.54,159.88 R23.2 34.53,163.59 U$5.7 | v77.06,91.47 77.06,91.21 76.5,90.65 45.77,90.65 43.59,92.84 27.48,92.84 23.16,97.16 23.16,98.32 v22.81,98.68
  Bottom 0.203: J2.2 64.42,17.1 65.13,17.81 69.14,17.81 v70.46,19.13 | 77.22,88.52 77.22,84.86 79.81,82.27 83.36,82.27 84.02,81.61 84.02,19.99 81.94,17.91 77.72,17.91 | JP8.3 34.47,151.99 34.29,152.17
  Bottom 0.254: U$5.7 34.29,152.17 34.29,148.34 35.56,147.07 35.56,144.78 U$4.7 35.56,142.24 35.56,124.21 34.54,123.19 U$6.7 34.29,107.7 33.02,106.43 33.02,104.14 U$1.7 34.29,99.31 33.66,98.68 v22.81,98.68 | 77.72,17.91 73.53,17.91 72.52,16.89 72.52,13.64 J2.4 | 77.22,88.52 77.27,91.06 77.27,91.26 v77.06,91.47
RS2-B  (via drill 0.6)
  Top 0.203: J2.13 66.29,7.04 J2.15
  Top 0.254: U2.7 39.37,96.77 v38.68,96.8 | R48.2 R23.1 36.33,163.33 U$5.8 | v74.88,92.08 45.97,92.08 v45.82,92.23
  Bottom 0.203: J2.15 70.46,9.59 70.46,16.59 72.54,18.67 81.13,18.67 83.46,21.01 83.46,81.15 83.16,81.46 79.55,81.46 76.35,84.66 76.35,88.21 | JP8.4 36.96,151.74 36.83,151.87
  Bottom 0.254: U$5.8 36.83,151.87 36.83,148.34 38.1,147.07 38.1,144.78 U$4.8 38.1,142.24 38.1,124.21 37.08,123.19 U$6.8 36.83,107.7 35.56,106.43 35.56,104.14 U$1.8 36.88,98.2 37.39,97.69 38.51,96.77 v38.68,96.8 38.76,96.72 38.76,94.87 39.83,93.8 44.3,93.8 45.82,92.33 v45.82,92.23 | 76.35,88.21 76.35,90.55 v74.88,92.08
RS3-A
  Top 0.254: R49.1 24.38,150.74 R50.2 24.5,146.42 U$4.35
  Bottom 0.254: U$1.35 24.13,121.16 25.4,122.43 25.4,144.78 U$4.35
RS3-B
  Top 0.254: R51.2 26.3,152.65 R50.1 26.3,146.42 U$4.36
  Bottom 0.254: U$1.36 26.67,121.16 27.94,122.43 27.94,144.78 U$4.36
RX  (via drill 0.6)
  Top 0.203: U2.1 54.58,95.5 LED1.C
  Top 0.254: 54.58,95.5 54.03,95.5 53.95,95.58 54.15,95.58 54.2,95.63 54.2,97 v54.36,97.16 | v57.1,75.92 54.91,75.92 U1.1
  Bottom 0.254: v54.36,97.16 54.36,93.14 55.78,91.72 55.78,76.53 56.39,75.92 v57.1,75.92
SAS-P
  Top 0.305: R58.2 76.71,21.82 75.7,20.82
  Top 1.422: 61.52,33.78 60.71,33.78 59.94,33.02 59.94,24.13 62.87,21.21 75.31,21.21 75.7,20.82 76.33,20.19 76.33,13.65 J2.5
  pour Top (no thermals): 61.11,32.74 63.2,32.74 63.3,32.84 63.3,37.47 63.14,37.62 60.2,37.62 59.89,37.31 59.89,33.3 60.45,32.74
SSW_C_SEN
  Top 0.203: U$6.25 80.01,118.57 78.94,117.5 14.78,117.5 11.43,114.15 2.9,114.15 2.44,113.69 2.44,50.93 2.95,50.42 2.95,49.5 2.08,48.64 2.08,12.4 3.05,11.43 6.73,11.43 7.37,10.8 7.37,8.13 8,7.49 15.32,7.49 J1.10
SSW_L-SEN
  Top 0.203: U$6.27 85.04,123.14 85.04,117.65 83.67,116.28 15.54,116.28 12.04,112.78 4.11,112.78 3.66,112.32 3.66,51.38 3.96,51.08 3.96,48.79 3.35,48.18 3.35,13.23 3.81,12.78 7.26,12.78 8.79,11.25 11.73,11.25 12.09,11.61 14.17,11.61 14.58,11.2 15.75,11.2 16.15,11.61 18.29,11.61 18.75,11.15 20.73,11.15 21.08,10.8 21.08,9.61 J1.11
SSW_R-SEN
  Top 0.203: U$6.26 82.45,123.09 82.45,118.11 81.23,116.89 15.24,116.89 11.89,113.54 3.51,113.54 3.05,113.08 3.05,51.18 3.45,50.77 3.45,49.1 2.74,48.39 2.74,12.75 3.3,12.19 6.99,12.19 8.13,11.05 8.13,9.78 8.51,9.4 13.1,9.4 J1.9
TO-TSMS
  Bottom 1.676: K8.14 10.15,70.35 11.94,72.14 16.89,72.14 17.65,71.37 17.65,32.82 17.75,32.82 17.93,32.64 17.98,32.64 18.14,32.49 31.6,32.49 35.2,28.88 J1.7 35.18,13.52
TSA
  Bottom 0.203: 86,100.46 85.55,100 85.6,84.25 85.6,17.35 86.77,16.18 89.26,16.18 90.37,15.06 90.37,12.42 88.39,10.69 88.39,8.66 86.51,6.78 85.65,6.78 J2.30 | JP8.5 40.69,149.17 41.35,148.51 42.52,148.51 43.18,147.9 43.18,144.15 43.43,143.84 44.12,143.84 U$4.11
  Bottom 0.254: 86,100.46 104.39,100.46 104.9,100.97 104.9,135.64 103.05,137.54 46.1,137.54 44.45,139.19 U$4.11 | J2.25 64.42,2.76 65.41,1.78 83.57,1.78 84.46,2.67 84.46,5.52 J2.30
TSB  (via drill 0.6)
  Top 0.203: v90.07,2.67 81.79,2.67 81.08,3.38 81.08,4.9 J2.29
  Bottom 0.203: 86.56,99.64 86.16,99.24 86.11,83.54 86.11,17.81 87.17,16.74 93.07,16.74 94.44,15.37 94.44,12.42 93.57,11.71 92.51,10.85 92.46,10.8 92.46,8.66 90.42,6.63 90.42,3.02 v90.07,2.67 | JP8.6 43.23,149.38 44.3,148.31 45.36,148.31 45.72,147.96 45.72,144.78 U$4.12
  Bottom 0.254: 86.56,99.64 104.75,99.77 104.85,99.77 105.66,100.58 105.66,136.65 103.38,138.94 48.51,138.94 46.99,140.46 U$4.12 | J2.26 68.42,3.21 69.09,2.54 80.01,2.54 80.52,3.05 80.52,5.46 J2.29
TSMS-SEN  (via drill 0.6)
  Top 0.203: U$6.21 69.85,120.52 69.41,120.08 12.07,120.08 10.86,121.29 2.48,121.29 v1.08,119.89
  Bottom 0.203: v1.08,119.89 1.08,2.54 1.84,1.78 22.16,1.78 23.18,2.79 23.18,5.48 J1.19
TSS-P
  Top 0.254: R27.2 52.82,52.56 53.09,52.3
  Top 1.422: 59.94,58.17 56.01,58.17 53.09,55.25 53.09,52.3 53.09,16 58.29,10.8 58.29,8.26 60.42,6.13 J2.24 60.42,3.33 61.21,2.54 75.82,2.54 76.45,3.18 76.45,5.52 J2.28
  pour Top (no thermals): 59.59,60.38 63.4,60.33 63.75,59.97 63.75,55.8 63.4,55.45 59.59,55.45
TX  (via drill 0.6)
  Top 0.203: U2.4 54.45,99.31 LED2.C
  Top 0.254: LED2.C 54.71,98.98 54.41,99.29 v52.78,99.29 | v54.51,74.7 53.77,74.7 U1.44
  Bottom 0.254: v52.78,99.29 52.78,93.45 55.07,91.16 55.07,75.36 v54.51,74.7
U2-CNT  (via drill 0.6)
  Top 0.254: U2.3 49.35,97.41 | 49.35,97.41 U2.2 | U1.43 52.3,75.59 52.17,75.72 50.5,75.72 v50.24,75.97 | v51.61,97.41 49.35,97.41
  Bottom 0.254: v50.24,75.97 50.29,75.97 50.44,75.82 53.29,75.82 53.64,76.17 53.64,91.36 51.97,93.04 51.97,97.1 v51.61,97.41
VCCIO  (via drill 0.5)
  Top 0.254: v67.16,32.33 U8.EP | U10.EP v67.36,46.36
  Top 0.406: v93.37,87.96 93.27,87.96 93.17,87.86 | v67.36,60.78 67.36,60.58 67.77,60.17 U5.EP 67.77,59.97 67.16,60.58 | v67.16,32.33 67.16,32.13 67.56,31.72 67.16,32.23 67.56,31.52 66.95,32.13 | v67.36,46.36 67.36,46.15 67.77,45.75 67.36,46.25 67.77,45.54 67.16,46.15
  Top 0.813: C7.A 97.84,92.74 v98.96,91.62
  Bottom 0.406: R26.1 93.17,87.76 v93.37,87.96 | v67.36,60.78 67.36,60.07 67.77,59.66 | v67.16,32.33 67.16,31.62 67.56,31.22 | v67.36,46.36 67.36,45.64 67.77,45.24
  other vias: 66.55,59.77 98.96,90.25 98.96,88.87 98.96,87.5 98.96,86.13 99.97,90.96 99.97,89.53 99.97,88.21 99.97,86.84 99.97,85.37 99.97,92.38 62.99,82.47 64.87,82.47 66.7,82.47 68.38,82.47 71.68,75.67 65.74,62.81 67.36,62.81 68.99,62.81 66.55,61.8 68.17,61.8 65.74,60.78 68.99,60.78 68.17,59.77 65.74,58.75 67.36,58.75 68.99,58.75 66.55,57.73 68.17,57.73 66.55,63.83 68.17,63.83 66.34,31.32 65.53,34.37 67.16,34.37 68.78,34.37 66.34,33.35 67.97,33.35 65.53,32.33 68.78,32.33 67.97,31.32 65.53,30.3 67.16,30.3 68.78,30.3 66.34,29.29 67.97,29.29 66.34,35.38 67.97,35.38 66.55,45.34 65.74,48.39 67.36,48.39 68.99,48.39 66.55,47.37 68.17,47.37 65.74,46.36 68.99,46.36 68.17,45.34 65.74,44.32 67.36,44.32 68.99,44.32 66.55,43.31 68.17,43.31 66.55,49.4 68.17,49.4 69.9,75.67 66.5,75.67 65.02,75.67 62.18,75.67
  pour Route15 (isolate 0.406): 69.34,93.73 100.84,93.73 101.98,92.33 101.98,84.33 99.9,82.35 83.01,82.35 80.52,79.76 80.52,72.26 73.28,65.02 73.28,27.43 70.1,24.26 61.98,24.26 60.45,25.78 60.45,84.84
  pour Top: 95.15,92.2 95.15,85.09 95.91,84.33 101.09,84.33 101.85,85.09 101.85,92.07 101.22,92.71 95.66,92.71
  pour Bottom: 61.67,66.32 61.67,82.22 62.94,83.49 70.46,83.49 72.19,81.76 72.19,27.61 69.39,24.82 62.84,24.82 61.93,25.73 61.93,66.07
VGND
  Top 0.254: L1.IN- 105.75,22.31 105.66,22.23
  Bottom 1.27: C23.2 100.86,13.99 J2.11
  pour Top (no thermals): 98.93,12.45 98.93,17.02 100.46,18.54 105.16,18.54 105.16,22.99 105.54,23.37 107.95,23.37 108.08,13.21 107.06,12.19 99.19,12.19
VIN
  Bottom 1.27: C23.1 96.96,14.09 J2.10
  pour Top (no thermals): 99.95,19.56 104.65,19.56 104.65,22.99 104.27,23.37 99.06,23.37 98.04,22.35 94.11,22.35 91.44,20.45 91.44,16.38 90.93,15.11 90.8,12.7 91.44,12.07 97.41,12.07 98.04,12.7 98.04,17.53
  pour Top (no thermals): 91.44,28.45 95.12,28.45 95.63,27.94 95.63,24.89 98.68,21.84 98.68,21.59 96.14,19.05 94.61,18.29 91.44,20.57
VSENSE
  Top 0.254: R14.1 42.29,50.18 R13.2 42.44,50.33 C27.1 40.47,50.33 39.73,50.98 39.73,73.08 40.23,73.58 40.23,85.57 41.86,87.2 46.33,87.2 46.69,86.84 46.69,85.75 U1.20
VSENSE2
  Top 0.305: C26.1 42.72,37.78 R8.2 42.27,35.47 R9.1

## Text on the board
tPlace: IS | TM | SS | ECU | RJ
_tsilk: IS | C4 | R12 | R17 | R23 | R11 | F1 | R51 | R16 | R48 | R49 | JP8 | F4 | R50 | TM | R5 | R6 | U$2 | C2 | F2 | SS | ECU | LED2 | R4 | + | LED1 | U2 | C7 | + | R3 | LED3 | + | R20 | LED6 | + | R10 | JP1 | RJ | U12 | R28 | R42 | U1 | C24 | C22 | C14 | R7 | K8 | C18 | C1 | U9 | C8 | U3 | C28 | R60 | R41 | C19 | R53 | R55 | R52 | R22 | U13 | R54 | R57 | 5V | Q1 | Q2 | + | 9V | + | + | VIN | R1 | C17 | LED10 | R25 | K7 | + | R15 | U5 | + | U10 | R13 | C6 | U14 | C27 | R27 | + | R46 | LED4 | R14 | LED12 | K1 | V1 | + | X1 | R8 | R47 | LED5 | U15 | C26 | R9 | LED11 | D3 | C5 | D9 | + | R21 | U6 | X2 | U8 | + | U11 | C25 | R59 | R43 | LED17 | C13 | LED8 | R58 | R18 | + | LED9 | L1 | + | R19 | LED14 | +
_bsilk: F3 | R40 | R26 | C9 | R39 | C11 | C10 | C3 | R24 | R2 | R29 | Q12 | C20 | D6 | R34 | C15 | R37 | Q13 | D8 | R36 | Q4 | D5 | R31 | R32 | D7 | C16 | Q6 | R38 | R35 | R33 | R30 | SJ1 | D1 | RPU13 | Q10 | C21 | RPU15 | QE4 | Q7 | RPU14 | C23 | U7 | R44 | R45